# EasyEDA Pro project 3SE_24_Power_Rune.eprj, schematic Armour_Demo2.0
Create Date: 2023-11-28; Page Name: P1; Project Name: 大符PCB; Schematic Name: Schematic1_1; Update Date: 2023-11-30; Company: 嘉立创EDA; Page Size: A4; Version: V1.0
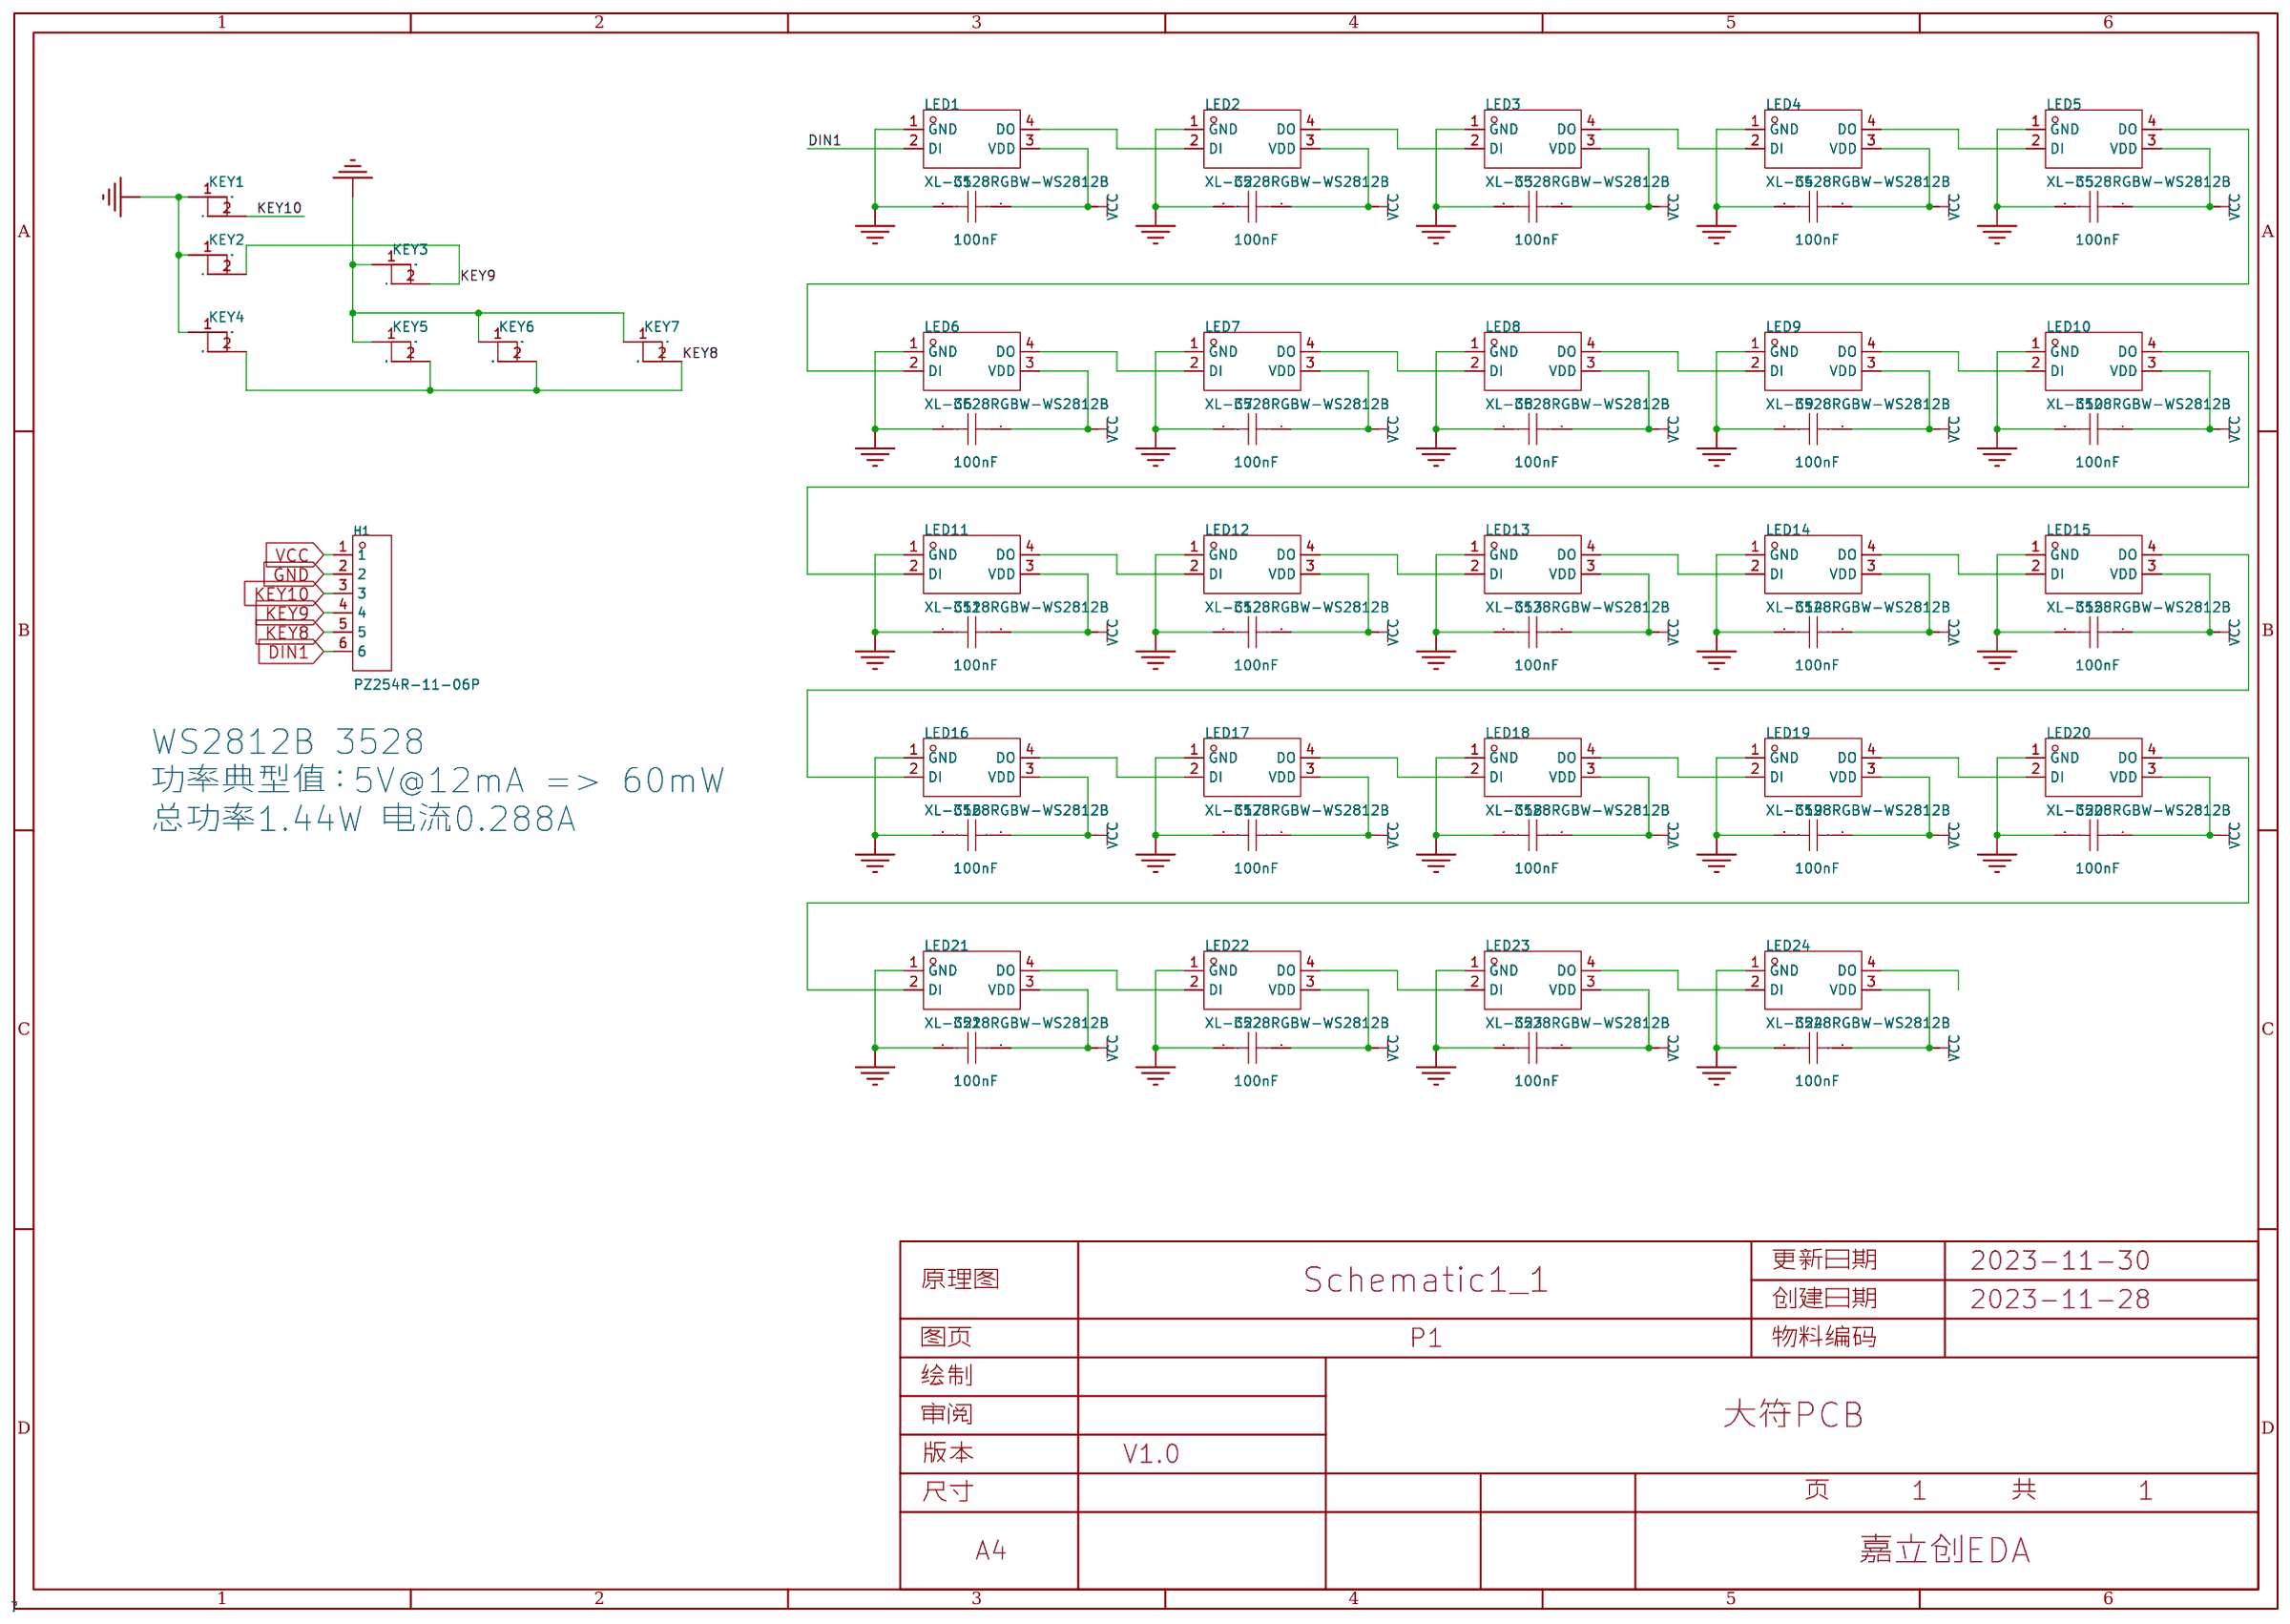
[diagram p6: schematic sheet]

## Parts
C1  100nF  [C0603]
C2  100nF  [C0603]
C3  100nF  [C0603]
C4  100nF  [C0603]
C5  100nF  [C0603]
C6  100nF  [C0603]
C7  100nF  [C0603]
C8  100nF  [C0603]
C9  100nF  [C0603]
C10  100nF  [C0603]
C11  100nF  [C0603]
C12  100nF  [C0603]
C13  100nF  [C0603]
C14  100nF  [C0603]
C15  100nF  [C0603]
C16  100nF  [C0603]
C17  100nF  [C0603]
C18  100nF  [C0603]
C19  100nF  [C0603]
C20  100nF  [C0603]
C21  100nF  [C0603]
C22  100nF  [C0603]
C23  100nF  [C0603]
C24  100nF  [C0603]
H1  PZ254R-11-06P  [HDR-TH_6P-P2.54-H-M-W10.4]
KEY1  -  [热插拔轴座]
KEY2  -  [热插拔轴座]
KEY3  -  [热插拔轴座]
KEY4  -  [热插拔轴座]
KEY5  -  [热插拔轴座]
KEY6  -  [热插拔轴座]
KEY7  -  [热插拔轴座]
LED1  XL-3528RGBW-WS2812B  [LED-SMD_4P-L3.5-W2.8-BR-1]
LED2  XL-3528RGBW-WS2812B  [LED-SMD_4P-L3.5-W2.8-BR-1]
LED3  XL-3528RGBW-WS2812B  [LED-SMD_4P-L3.5-W2.8-BR-1]
LED4  XL-3528RGBW-WS2812B  [LED-SMD_4P-L3.5-W2.8-BR-1]
LED5  XL-3528RGBW-WS2812B  [LED-SMD_4P-L3.5-W2.8-BR-1]
LED6  XL-3528RGBW-WS2812B  [LED-SMD_4P-L3.5-W2.8-BR-1]
LED7  XL-3528RGBW-WS2812B  [LED-SMD_4P-L3.5-W2.8-BR-1]
LED8  XL-3528RGBW-WS2812B  [LED-SMD_4P-L3.5-W2.8-BR-1]
LED9  XL-3528RGBW-WS2812B  [LED-SMD_4P-L3.5-W2.8-BR-1]
LED10  XL-3528RGBW-WS2812B  [LED-SMD_4P-L3.5-W2.8-BR-1]
LED11  XL-3528RGBW-WS2812B  [LED-SMD_4P-L3.5-W2.8-BR-1]
LED12  XL-3528RGBW-WS2812B  [LED-SMD_4P-L3.5-W2.8-BR-1]
LED13  XL-3528RGBW-WS2812B  [LED-SMD_4P-L3.5-W2.8-BR-1]
LED14  XL-3528RGBW-WS2812B  [LED-SMD_4P-L3.5-W2.8-BR-1]
LED15  XL-3528RGBW-WS2812B  [LED-SMD_4P-L3.5-W2.8-BR-1]
LED16  XL-3528RGBW-WS2812B  [LED-SMD_4P-L3.5-W2.8-BR-1]
LED17  XL-3528RGBW-WS2812B  [LED-SMD_4P-L3.5-W2.8-BR-1]
LED18  XL-3528RGBW-WS2812B  [LED-SMD_4P-L3.5-W2.8-BR-1]
LED19  XL-3528RGBW-WS2812B  [LED-SMD_4P-L3.5-W2.8-BR-1]
LED20  XL-3528RGBW-WS2812B  [LED-SMD_4P-L3.5-W2.8-BR-1]
LED21  XL-3528RGBW-WS2812B  [LED-SMD_4P-L3.5-W2.8-BR-1]
LED22  XL-3528RGBW-WS2812B  [LED-SMD_4P-L3.5-W2.8-BR-1]
LED23  XL-3528RGBW-WS2812B  [LED-SMD_4P-L3.5-W2.8-BR-1]
LED24  XL-3528RGBW-WS2812B  [LED-SMD_4P-L3.5-W2.8-BR-1]

## Library data of the parts
C1-C24 = CC0603KRX7R9BB104: 容值:100nF;精度:±10%;额定电压:50V;材质(温度系数):X7R;; LCSC Part Name: 100nF ±10% 50V; Supplier Part: C14663; Manufacturer: YAGEO(国巨); Supplier Footprint: 0603; JLCPCB Part Class: Basic Part; Datasheet: https://atta.szlcsc.com/upload/public/pdf/source/20180910/C282072_33301C7F631E79921B82A8DAC6BCC5B3.pdf; Supplier: LCSC; Tolerance: ±10%; Voltage Rated: 50V; Temperature Coefficient: X7R
H1 = PZ254R-11-06P: 排数:单排;总PIN位数:6P;间距:2.54mm;插针结构:1x6P;行距:-;安装类型:弯插;圆针/方针:方针;额定电流:-;额定电压:-;配合针长度:6mm;塑高:2.5mm;触头材质:黄铜;触头镀层:-;工作温度范围:-40℃~+105℃;颜色:黑色;; LCSC Part Name: 2.54mm 1x6P 弯插 方针; Supplier Part: C492414; Manufacturer: XFCN(兴飞); Supplier Footprint: 弯插,P=2.54mm; JLCPCB Part Class: 扩展库; Datasheet: https://atta.szlcsc.com/upload/public/pdf/source/20200309/C492414_188252315A8FC19F8382BF484DD4F4B8.pdf; Supplier: LCSC; Number of Rows: 单排; Number of Pins: 6P; Pitch: 2.54mm; Pin Structure: 1x6P; Mounting Type: 弯插; Circluar Pins/Square Pins: 方针; Length of Mating Pin: 6mm; Insulation Height: 2.5mm; Contact Material: 黄铜; Operating Temperature Range: -40℃~+105℃; Color: 黑色
KEY1-KEY7 = 热插拔轴座
LED1-LED24 = XL-3528RGBW-WS2812B: 发光颜色:RGB三色;二极管配置:-;功率:50mW；50mW；45mW;主波长:618nm~623nm；520nm~525nm；467nm~472nm;发光角度:120°;安装方式:正贴;工作温度:-25℃~+80℃;; LCSC Part Name: RGB三色 正贴 幻彩; Supplier Part: C2890364; Manufacturer: XINGLIGHT(成兴光); Supplier Footprint: SMD3528-4P; JLCPCB Part Class: 扩展库; Datasheet: https://atta.szlcsc.com/upload/public/pdf/source/20230707/D057C4FFF40CAC379BBCAAC4763A2431.pdf; Supplier: LCSC; Emitted Color: RGB三色; Forward Current: 20mA; Power Dissipation: 50mW；50mW；45mW; Dominant Wavelength: 618nm~623nm；520nm~525nm；467nm~472nm; Peak Wavelength: 525nm；623nm；472nm; Viewing Angle: 120°; Mounting Sytle: 正贴; Operating Temperature: -25℃~+80℃

## Nets
GND: C1.2 C2.2 C3.2 C4.2 C5.2 C6.2 C7.2 C8.2 C9.2 C10.2 C11.2 C12.2 C13.2 C14.2 C15.2 C16.2 C17.2 C18.2 C19.2 C20.2 C21.2 C22.2 C23.2 C24.2 H1.2 KEY1.1(Pin1) KEY2.1(Pin1) KEY3.1(Pin1) KEY4.1(Pin1) KEY5.1(Pin1) KEY6.1(Pin1) KEY7.1(Pin1) LED1.1(GND) LED2.1(GND) LED3.1(GND) LED4.1(GND) LED5.1(GND) LED6.1(GND) LED7.1(GND) LED8.1(GND) LED9.1(GND) LED10.1(GND) LED11.1(GND) LED12.1(GND) LED13.1(GND) LED14.1(GND) LED15.1(GND) LED16.1(GND) LED17.1(GND) LED18.1(GND) LED19.1(GND) LED20.1(GND) LED21.1(GND) LED22.1(GND) LED23.1(GND) LED24.1(GND)
VCC: C1.1 C2.1 C3.1 C4.1 C5.1 C6.1 C7.1 C8.1 C9.1 C10.1 C11.1 C12.1 C13.1 C14.1 C15.1 C16.1 C17.1 C18.1 C19.1 C20.1 C21.1 C22.1 C23.1 C24.1 H1.1 LED1.3(VDD) LED2.3(VDD) LED3.3(VDD) LED4.3(VDD) LED5.3(VDD) LED6.3(VDD) LED7.3(VDD) LED8.3(VDD) LED9.3(VDD) LED10.3(VDD) LED11.3(VDD) LED12.3(VDD) LED13.3(VDD) LED14.3(VDD) LED15.3(VDD) LED16.3(VDD) LED17.3(VDD) LED18.3(VDD) LED19.3(VDD) LED20.3(VDD) LED21.3(VDD) LED22.3(VDD) LED23.3(VDD) LED24.3(VDD)
DIN1: H1.6 LED1.2(DI)
KEY8: H1.5 KEY4.2(Pin2) KEY5.2(Pin2) KEY6.2(Pin2) KEY7.2(Pin2)
KEY9: H1.4 KEY2.2(Pin2) KEY3.2(Pin2)
KEY10: H1.3 KEY1.2(Pin2)
$1N1766: LED1.4(DO) LED2.2(DI)
$1N1873: LED2.4(DO) LED3.2(DI)
$1N1984: LED3.4(DO) LED4.2(DI)
$1N6115: LED4.4(DO) LED5.2(DI)
$1N6897: LED7.4(DO) LED8.2(DI)
$1N6903: LED8.4(DO) LED9.2(DI)
$1N6915: LED9.4(DO) LED10.2(DI)
$1N6929: LED6.4(DO) LED7.2(DI)
$1N6940: LED5.4(DO) LED6.2(DI)
$1N7432: LED12.4(DO) LED13.2(DI)
$1N7438: LED13.4(DO) LED14.2(DI)
$1N7450: LED14.4(DO) LED15.2(DI)
$1N7454: LED11.4(DO) LED12.2(DI)
$1N7458: LED10.4(DO) LED11.2(DI)
$1N7998: LED17.4(DO) LED18.2(DI)
$1N8004: LED18.4(DO) LED19.2(DI)
$1N8016: LED19.4(DO) LED20.2(DI)
$1N8020: LED16.4(DO) LED17.2(DI)
$1N8024: LED15.4(DO) LED16.2(DI)
$1N8502: LED22.4(DO) LED23.2(DI)
$1N8508: LED23.4(DO) LED24.2(DI)
$1N8524: LED21.4(DO) LED22.2(DI)
$1N8528: LED20.4(DO) LED21.2(DI)

Not connected (* = marked no-connect by the designer): LED24 4(DO)

## Notes on the sheet
- WS2812B 3528
  功率典型值：5V@12mA => 60mW
  总功率1.44W 电流0.288A
